# EasyEDA Pro project Archive.eprj, board GPR2.0
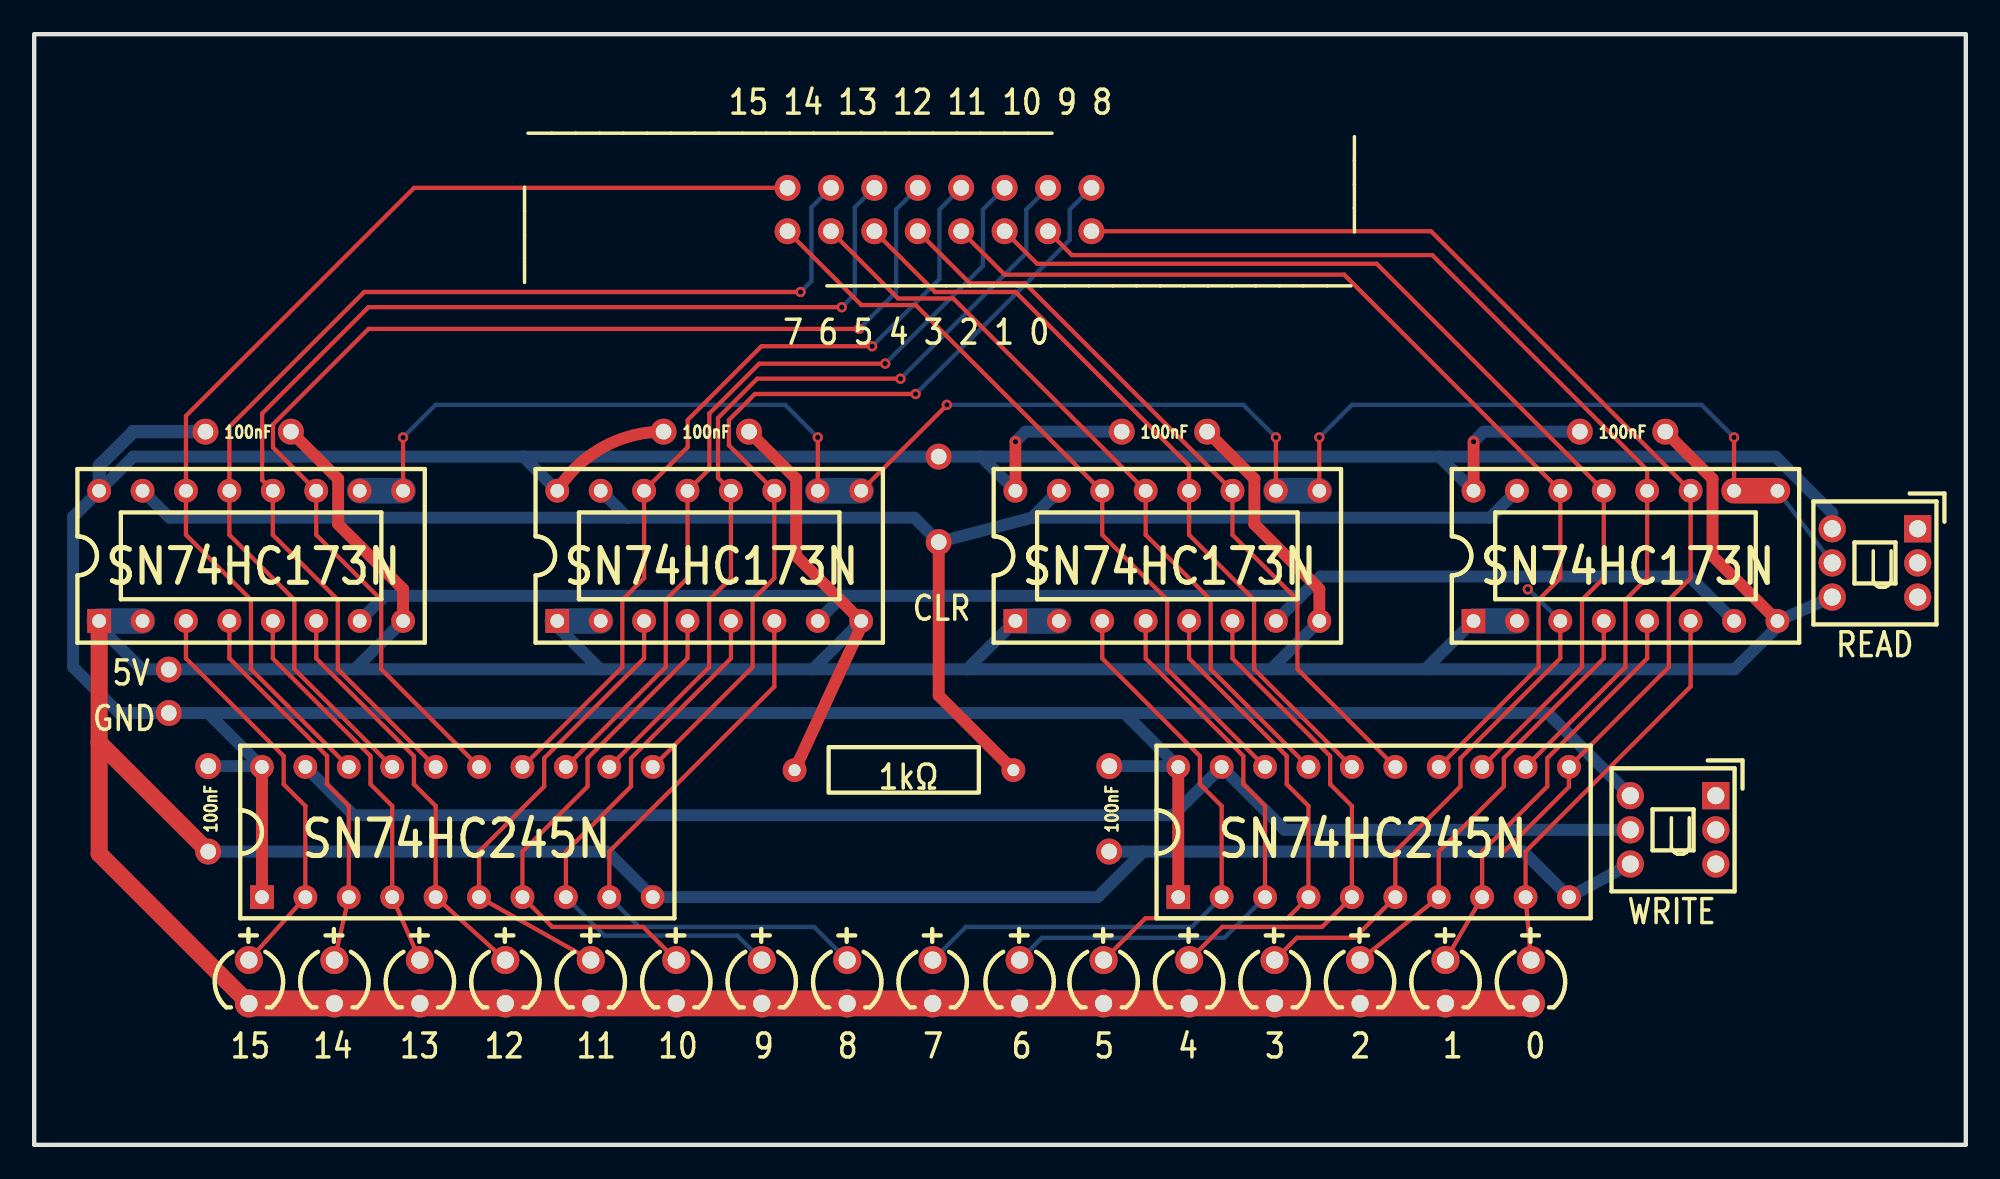
[diagram p6: board, top side]
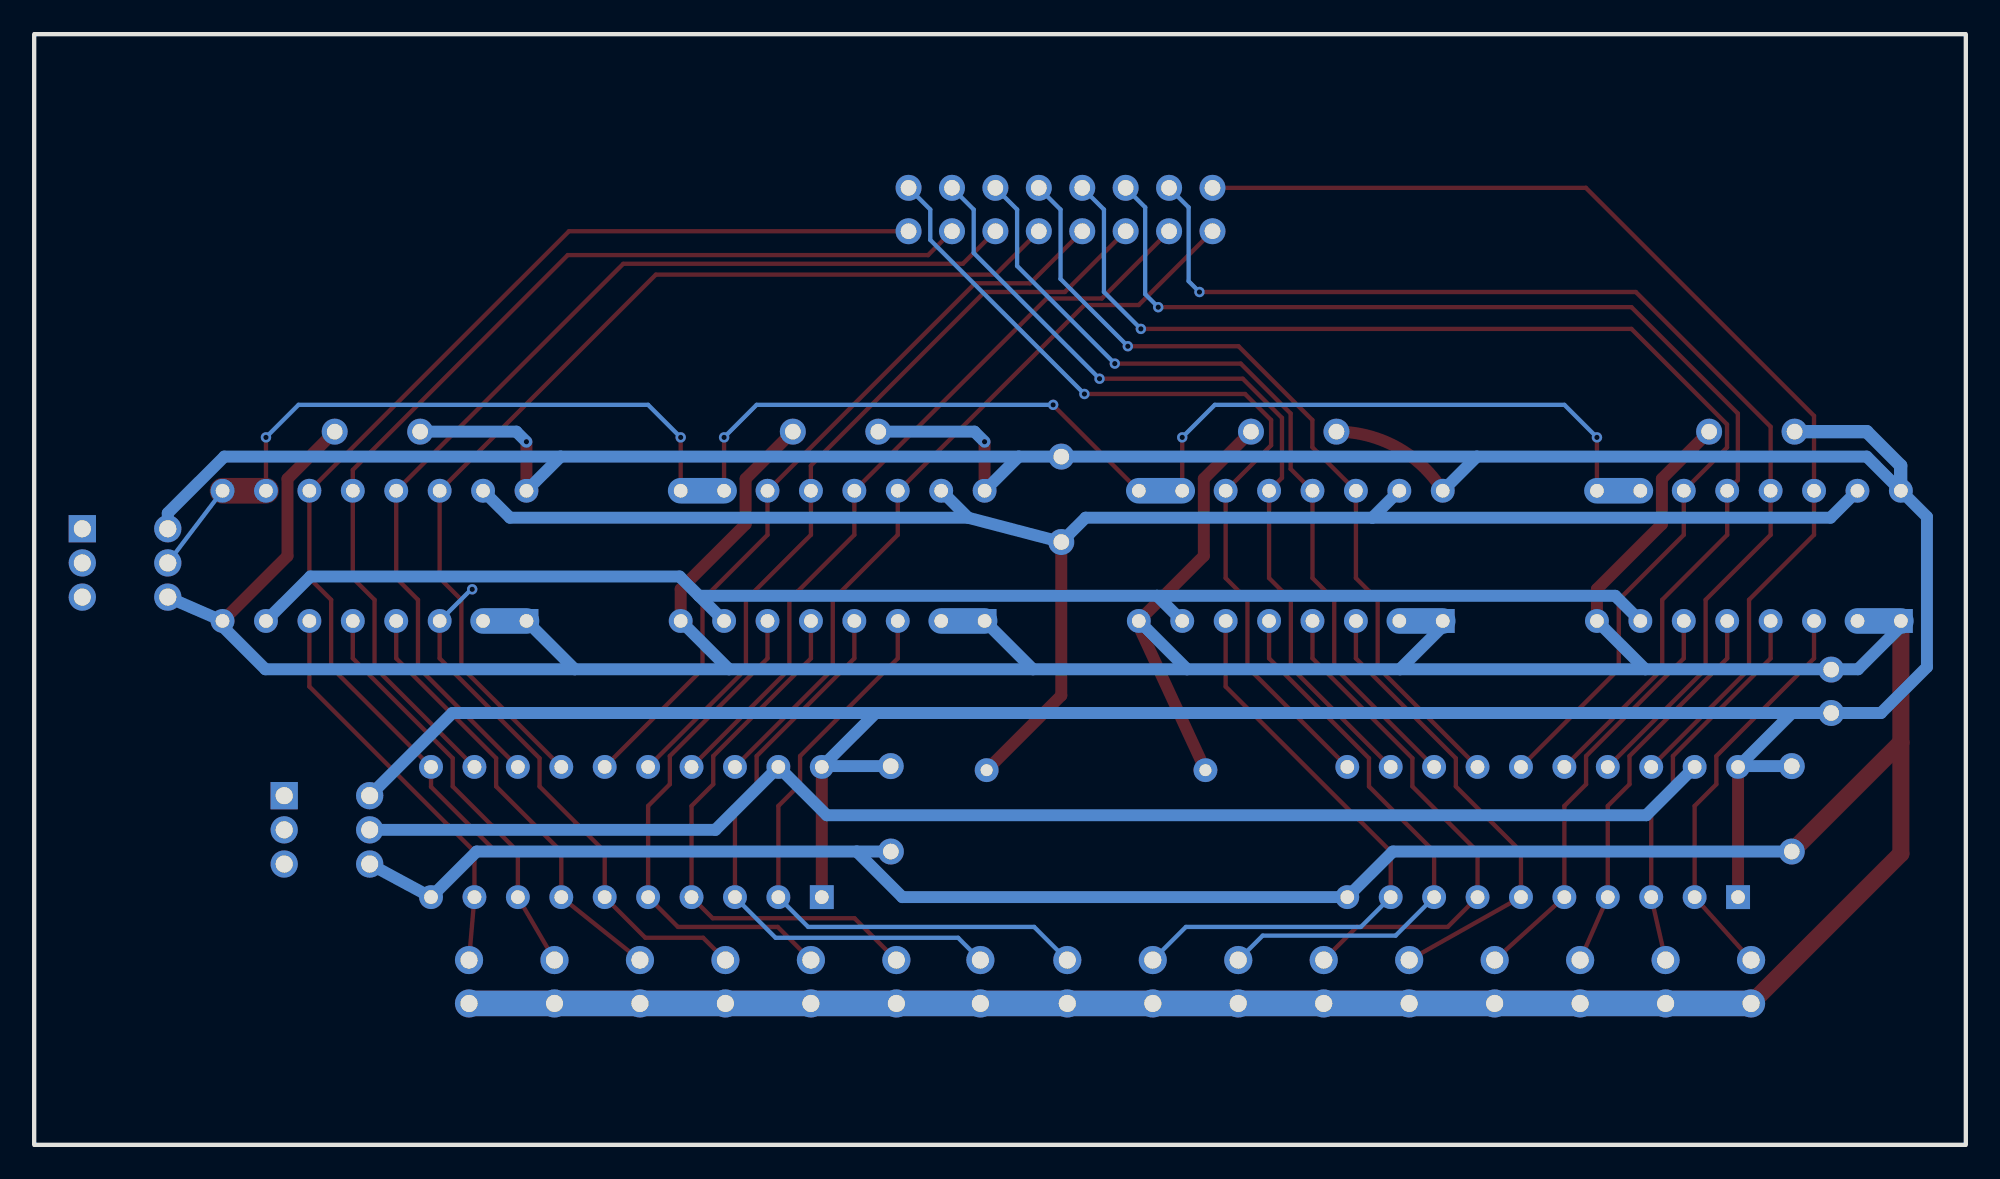
[diagram p7: board, bottom side, seen from below]

Outline 113 x 65 mm; copper layers: Top Layer, Bottom Layer. Coordinates in mm from the lower left corner of the outline.
Outline path: rectangle 0,65 113,0
Stack: Top Layer 0.035mm / Dielectric1 1.51mm FR4 er 4.5 / Bottom Layer 0.035mm

## Design rules (mm)
template: JLCPCB Capability(Two Layers Board)
spacing copperThickness1oz (default): track to track 0.102, other pairs 0.152 to 0.3
spacing copperThickness2oz: track to track 0.203, other pairs 0.152 to 0.3
track width copperThickness1oz (default): min 0.127, default 0.254, max 2.54
track width copperThickness2oz: min 0.203, default 0.254, max 2.54
differential pair differentialPair (default): width min 0.127, default 0.254, max 2.54; gap min 0.152, default 0.152
via viaSize (default): diameter min 0.5, default 0.61, max 10; hole min 0.3, default 0.305, max 6.3

## Placement (name value [footprint] x y rotation side)
NOREF  -  [Pad_e1288]  10.02 41.74 90 top
NOREF#2  -  [Pad_e1300]  62.89 22.16 180 top
NOREF#3  -  [Pad_e1421]  46.61 53.47 0 top
NOREF#4  -  [Pad_e1291]  41.82 41.74 90 top
NOREF#5  -  [Pad_e1292]  52.91 40.28 0 top
NOREF#6  -  [Pad_e1424]  49.15 53.47 0 top
NOREF#7  -  [Pad_e1430]  56.77 56.01 0 top
NOREF#8  -  [Pad_e1295]  10.18 22.16 180 top
NOREF#9  -  [Pad_e8]  7.87 27.81 0 top
NOREF#10  -  [Pad_e1434]  61.85 56.01 0 top
NOREF#11  -  [Pad_e1422]  46.61 56.01 0 top
NOREF#12  -  [Pad_e1423]  49.15 56.01 0 top
NOREF#13  -  [Pad_e1425]  51.69 53.47 0 top
NOREF#14  -  [Pad_e1429]  56.77 53.47 0 top
NOREF#15  -  [Pad_e1296]  52.91 35.28 0 top
NOREF#16  -  [Pad_e1420]  44.07 53.47 0 top
NOREF#17  -  [Pad_e1419]  44.07 56.01 0 top
NOREF#18  -  [Pad_e1433]  61.85 53.47 0 top
NOREF#19  -  [Pad_e1428]  54.23 53.47 0 top
NOREF#20  -  [Pad_e1293]  63.62 41.74 90 top
NOREF#21  -  [Pad_e9]  7.87 25.27 0 top
NOREF#22  -  [Pad_e1297]  68.62 41.74 90 top
NOREF#23  -  [Pad_e1432]  59.31 53.47 0 top
NOREF#24  -  [Pad_e1290]  36.82 41.74 90 top
NOREF#25  -  [Pad_e1301]  62.88 17.16 0 top
NOREF#26  -  [Pad_e1294]  10.18 17.16 180 top
NOREF#27  -  [Pad_e1289]  15.02 41.74 90 top
NOREF#28  -  [Pad_e1427]  54.23 56.01 0 top
NOREF#29  -  [Pad_e1426]  51.69 56.01 0 top
NOREF#30  -  [Pad_e1298]  90.42 41.74 90 top
NOREF#31  -  [Pad_e1299]  95.42 41.74 90 top
NOREF#32  -  [Pad_e1431]  59.31 56.01 0 top
SK1  -  [DIP-16_4816-3000-CP]  39.49 34.47 0 top
SK1#2  -  [DIP-16_4816-3000-CP]  12.69 34.47 0 top
SK1#3  -  [DIP-16_4816-3000-CP]  66.29 34.47 0 top
SK1#4  -  [DIP-16_4816-3000-CP]  93.09 34.47 0 top
SK2  -  [DIP-20_L25.4-W10.1-P2.54-LS7.6-BL]  24.75 18.31 0 top
SK2#2  -  [DIP-20_L25.4-W10.1-P2.54-LS7.6-BL]  78.36 18.31 0 top
SW2  -  [SW-TH_6P-L7.0-W7.0-P2.00]  95.87 18.43 0 top
SW2#2  -  [SW-TH_6P-L7.0-W7.0-P2.00]  107.69 34.06 0 top
U9  AXIAL-0.4  [RES-TH_BD2.7-L8.8-P12.80-D0.5]  50.88 21.93 0 top
U14  -  [LED-TH_BD4.0-P2.54-FD_RED]  87.56 9.54 270 top
U14#2  -  [LED-TH_BD4.0-P2.54-FD_RED]  12.56 9.54 270 top
U14#3  -  [LED-TH_BD4.0-P2.54-FD_RED]  17.56 9.54 270 top
U14#4  -  [LED-TH_BD4.0-P2.54-FD_RED]  22.56 9.54 270 top
U14#5  -  [LED-TH_BD4.0-P2.54-FD_RED]  27.56 9.54 270 top
U14#6  -  [LED-TH_BD4.0-P2.54-FD_RED]  32.56 9.54 270 top
U14#7  -  [LED-TH_BD4.0-P2.54-FD_RED]  37.56 9.54 270 top
U14#8  -  [LED-TH_BD4.0-P2.54-FD_RED]  42.56 9.54 270 top
U14#9  -  [LED-TH_BD4.0-P2.54-FD_RED]  47.56 9.54 270 top
U14#10  -  [LED-TH_BD4.0-P2.54-FD_RED]  52.56 9.54 270 top
U14#11  -  [LED-TH_BD4.0-P2.54-FD_RED]  57.65 9.54 270 top
U14#12  -  [LED-TH_BD4.0-P2.54-FD_RED]  62.56 9.54 270 top
U14#13  -  [LED-TH_BD4.0-P2.54-FD_RED]  67.56 9.54 270 top
U14#14  -  [LED-TH_BD4.0-P2.54-FD_RED]  72.56 9.54 270 top
U14#15  -  [LED-TH_BD4.0-P2.54-FD_RED]  77.56 9.54 270 top
U14#16  -  [LED-TH_BD4.0-P2.54-FD_RED]  82.56 9.54 270 top

## Footprints (pads in the part's own frame, mm; a bottom-side part is the same pattern mirrored in y, then rotated)
DIP-16_4816-3000-CP
  rect 1.4x1.4 hole 0.8: 1(-8.89,-3.81)
  round 1.4 hole 0.8: 2(-6.35,-3.81) 3(-3.81,-3.81) 4(-1.27,-3.81) 5(1.27,-3.81) 6(3.81,-3.81) 7(6.35,-3.81) 8(8.89,-3.81) 9(8.89,3.81) 10(6.35,3.81) 11(3.81,3.81) 12(1.27,3.81) 13(-1.27,3.81) 14(-3.81,3.81) 15(-6.35,3.81) 16(-8.89,3.81)
DIP-20_L25.4-W10.1-P2.54-LS7.6-BL
  rect 1.4x1.4 hole 0.8: 1(-11.43,-3.81)
  round 1.4 hole 0.8: 2(-8.89,-3.81) 3(-6.35,-3.81) 4(-3.81,-3.81) 5(-1.27,-3.81) 6(1.27,-3.81) 7(3.81,-3.81) 8(6.35,-3.81) 9(8.89,-3.81) 10(11.43,-3.81) 11(11.43,3.81) 12(8.89,3.81) 13(6.35,3.81) 14(3.81,3.81) 15(1.27,3.81) 16(-1.27,3.81) 17(-3.81,3.81) 18(-6.35,3.81) 19(-8.89,3.81) 20(-11.43,3.81)
LED-TH_BD4.0-P2.54-FD_RED
  round 1.651 hole 1: 1(-1.27,0) 2(1.27,0)
Pad_e8
  round 1.524 hole 0.914: 1(0,0)
Pad_e9
  round 1.524 hole 0.914: 2(0,0)
Pad_e1288
  round 1.524 hole 0.914: 2(0,0)
Pad_e1289
  round 1.524 hole 0.914: 1(0,0)
Pad_e1290
  round 1.524 hole 0.914: 2(0,0)
Pad_e1291
  round 1.524 hole 0.914: 1(0,0)
Pad_e1292
  round 1.524 hole 0.914: 2(0,0)
Pad_e1293
  round 1.524 hole 0.914: 2(0,0)
Pad_e1294
  round 1.524 hole 0.914: 1(0,0)
Pad_e1295
  round 1.524 hole 0.914: 2(0,0)
Pad_e1296
  round 1.524 hole 0.914: 1(0,0)
Pad_e1297
  round 1.524 hole 0.914: 1(0,0)
Pad_e1298
  round 1.524 hole 0.914: 2(0,0)
Pad_e1299
  round 1.524 hole 0.914: 1(0,0)
Pad_e1300
  round 1.524 hole 0.914: 2(0,0)
Pad_e1301
  round 1.524 hole 0.914: 1(0,0)
Pad_e1419
  round 1.524 hole 0.914: 1(0,0)
Pad_e1420
  round 1.524 hole 0.914: 1(0,0)
Pad_e1421
  round 1.524 hole 0.914: 2(0,0)
Pad_e1422
  round 1.524 hole 0.914: 2(0,0)
Pad_e1423
  round 1.524 hole 0.914: 3(0,0)
Pad_e1424
  round 1.524 hole 0.914: 3(0,0)
Pad_e1425
  round 1.524 hole 0.914: 2(0,0)
Pad_e1426
  round 1.524 hole 0.914: 2(0,0)
Pad_e1427
  round 1.524 hole 0.914: 3(0,0)
Pad_e1428
  round 1.524 hole 0.914: 3(0,0)
Pad_e1429
  round 1.524 hole 0.914: 2(0,0)
Pad_e1430
  round 1.524 hole 0.914: 2(0,0)
Pad_e1431
  round 1.524 hole 0.914: 3(0,0)
Pad_e1432
  round 1.524 hole 0.914: 3(0,0)
Pad_e1433
  round 1.524 hole 0.914: 2(0,0)
Pad_e1434
  round 1.524 hole 0.914: 2(0,0)
RES-TH_BD2.7-L8.8-P12.80-D0.5
  round 1.4 hole 0.7: 1(-6.4,0) 2(6.4,0)
SW-TH_6P-L7.0-W7.0-P2.00
  rect 1.6x1.6 hole 1: 1(2.499,2)
  round 1.6 hole 1: 2(2.5,0) 3(2.5,-2) 4(-2.5,2) 5(-2.5,0) 6(-2.5,-2)

## Nets

Pads without a net: NOREF 2; NOREF#2 2; NOREF#3 2; NOREF#4 1; NOREF#5 2; NOREF#6 3; NOREF#7 2; NOREF#8 2; NOREF#9 1; NOREF#10 2; NOREF#11 2; NOREF#12 3; NOREF#13 2; NOREF#14 2; NOREF#15 1; NOREF#16 1; NOREF#17 1; NOREF#18 2; NOREF#19 3; NOREF#20 2; NOREF#21 2; NOREF#22 1; NOREF#23 3; NOREF#24 2; NOREF#25 1; NOREF#26 1; NOREF#27 1; NOREF#28 3; NOREF#29 2; NOREF#30 2; NOREF#31 1; NOREF#32 3; SK1 1 2 3 4 5 6 7 8 9 10 11 12 13 14 15 16; SK1#2 1 2 3 4 5 6 7 8 9 10 11 12 13 14 15 16; SK1#3 1 2 3 4 5 6 7 8 9 10 11 12 13 14 15 16; SK1#4 1 2 3 4 5 6 7 8 9 10 11 12 13 14 15 16; SK2 1 2 3 4 5 6 7 8 9 10 11 12 13 14 15 16 17 18 19 20; SK2#2 1 2 3 4 5 6 7 8 9 10 11 12 13 14 15 16 17 18 19 20; SW2 1 2 3 4 5 6; SW2#2 1 2 3 4 5 6; U9 1 2; U14 1 2; U14#2 1 2; U14#3 1 2; U14#4 1 2; U14#5 1 2; U14#6 1 2; U14#7 1 2; U14#8 1 2; U14#9 1 2; U14#10 1 2; U14#11 1 2; U14#12 1 2; U14#13 1 2; U14#14 1 2; U14#15 1 2; U14#16 1 2

## Via types
v1: diameter 0.61, hole 0.305, Top Layer to Bottom Layer, 16 vias

## Routing (per net, layer and track width the routed paths; a pad name or vN(x,y) marks a point on that pad's centre or on a via; arc(x,y) is an arc through that point)
(no net): length 2498.6
  Top Layer w0.254: 62.48,30.34 62.48,28.47 68.2,22.75 68.2,21.1 69.47,19.83 SK2#2.2 ; SK2#2.18 66.28,27.84 66.28,31.9 62.48,35.7 SK1#3.14 62.43,38.28 51.56,49.15 48.39,49.15 NOREF#16.1 ; NOREF#23.3 60.71,52.07 81.79,52.07 94.36,39.5 94.36,33.17 93.09,31.9 93.09,27.96 SK2#2.12 ; v1(44.83,49.91) 19.3,49.91 11.42,42.03 SK1#2.13 11.42,35.7 15.22,31.9 15.22,27.84 SK2.17 ; SK1#4.10 v1(99.44,41.4) ; v1(49.02,46.74) 42.54,46.74 38.23,42.42 38.23,40.83 SK1.14 35.68,33.17 34.41,31.9 34.41,27.96 28.69,22.25 ; SK2.9 33.64,17.16 43.3,26.82 43.3,30.34 ; 67.56,30.34 67.56,28.47 73.28,22.75 73.28,21.1 74.55,19.83 SK2#2.4 73.31,13.26 65.01,13.26 U14#12.1 ; U14#2.1 SK2.2 15.86,19.83 14.59,21.1 14.59,22.75 8.88,28.47 8.88,30.34 ; U14#6.1 SK2.6 26.02,17.16 29.83,20.97 29.83,22.62 35.68,28.47 35.68,30.34 ; U14#7.1 35.62,12.75 30.31,12.75 SK2.7 28.56,17.16 32.37,20.97 32.37,22.62 38.22,28.47 38.22,30.34 ; U14#13.1 69.5,12.75 75.34,12.75 SK2#2.5 77.09,19.83 75.82,21.1 75.82,22.75 70.1,28.47 70.1,30.34 ; 91.82,30.34 91.82,28.47 85.98,22.62 85.98,20.97 82.17,17.16 SK2#2.7 U14#15.1 ; NOREF#13.2 54.74,50.42 57.96,50.42 SK1#3.11 70.1,35.7 73.9,31.9 73.9,27.84 SK2#2.15 ; U14#16.1 SK2#2.8 84.71,17.16 88.52,20.97 88.52,22.62 94.36,28.47 94.36,30.34 ; U14.1 SK2#2.9 87.25,17.16 96.9,26.82 96.9,30.34 ; NOREF#14.2 58.67,51.56 78.54,51.56 SK1#4.13 91.82,33.17 90.55,31.9 90.55,27.96 SK2#2.13 ; NOREF#18.2 81.71,53.47 SK1#4.11 96.9,33.17 95.63,31.9 95.63,27.96 SK2#2.11 89.79,20.95 85.98,17.14 ; 82.29,22.25 88.01,27.96 88.01,31.9 89.28,33.17 SK1#4.14 76.63,50.93 56.77,50.93 NOREF#19.3 ; NOREF#3.2 50.55,49.53 53.77,49.53 SK1#3.13 65.02,35.7 68.82,31.9 68.82,27.84 SK2#2.17 ; SK2#2.16 71.36,27.84 71.36,31.9 67.56,35.7 SK1#3.12 67.56,38.28 67.56,39.75 57.4,49.91 52.71,49.91 NOREF#6.3 ; SK2.16 17.76,27.84 17.76,31.9 13.96,35.7 13.96,38.28 13.33,38.9 13.33,42.8 19.56,49.02 v1(47.24,49.02) ; SK2.11 42.03,27.96 42.03,31.9 43.3,33.17 SK1.11 40.64,40.94 40.64,42.42 42.16,43.94 v1(51.56,43.94) ; U14#4.1 SK2.4 20.94,19.83 19.67,21.1 19.67,22.75 13.96,28.47 13.96,30.34 ; 11.42,30.34 11.42,28.47 17.13,22.75 17.13,21.1 18.4,19.83 SK2.3 U14#3.1 ; SK1#2.9 v1(21.58,41.4) ; v1(48.26,47.75) 19.56,47.75 13.97,42.16 13.97,40.81 SK1#2.11 16.5,35.7 20.3,31.9 20.3,27.84 SK2.15 ; SK2#2.3 72.01,19.83 70.74,21.1 70.74,22.75 65.02,28.47 65.02,30.34 ; NOREF#17.1 22.22,56.01 8.88,42.66 8.88,35.7 12.68,31.9 12.68,27.84 SK2.18 ; U14#5.1 SK2.5 23.48,19.83 22.21,21.1 22.21,22.75 16.5,28.47 16.5,30.34 ; SK1#3.9 v1(75.18,41.4) ; v1(50.68,44.84) 42.3,44.84 40,42.55 40,39.03 SK1.12 40.76,33.17 39.49,31.9 39.49,27.96 SK2.12 ; SK2.8 31.1,17.16 34.91,20.97 34.91,22.62 40.76,28.47 40.76,30.34 ; SK2.13 36.95,27.96 36.95,31.9 38.22,33.17 SK1.13 39.5,39.56 39.5,42.8 42.42,45.72 v1(49.78,45.72) ; SK1.9 53.41,43.31 ; U14#14.1 73.87,12.12 77.25,12.12 SK2#2.6 79.63,17.16 83.44,20.97 83.44,22.62 89.28,28.47 89.28,30.34 ; SK1.10 v1(45.84,41.4) ; SK1#3.10 v1(72.64,41.4)
  Top Layer w0.7: NOREF#22.1 71.38,38.98 71.38,36.32 75.18,32.52 75.18,30.66 ; 48.38,30.34 U9.1 ; NOREF#31.1 98.18,38.98 98.18,34.46 101.98,30.66 ; SK2#2.20 SK2#2.1 ; NOREF#4.1 44.58,38.98 44.58,34.46 48.38,30.66 ; SK1#3.16 57.4,38.28 v1(57.4,41.15) ; 84.2,38.28 84.2,38.28 v1(84.2,41.15) ; 21.58,30.66 21.58,32.52 17.78,36.32 17.78,38.98 NOREF#27.1 ; NOREF#15.1 52.91,26.3 U9.2 ; SK2.20 SK2.1 ; NOREF#24.2 arc(34.51,41.36) 32.43,40.28 arc(31.42,39.36) SK1.16
  Top Layer w1: 3.8,23.55 NOREF#26.1 ; 3.8,23.55 3.8,30.66 ; 3.8,23.55 3.8,17.04 U14#2.2
  Top Layer w1.5: SK1#4.10 SK1#4.9 ; U14.2 U14#16.2 U14#15.2 U14#14.2 U14#13.2 U14#12.2 U14#11.2 U14#10.2 U14#9.2 U14#8.2 U14#7.2 U14#6.2 U14#5.2 U14#4.2 U14#3.2 U14#2.2
  Bottom Layer w0.254: v1(47.24,49.02) 48.01,49.78 48.01,54.86 NOREF#12.3 ; U14#10.1 54.5,12.75 67.72,12.75 SK2#2.2 ; NOREF#7.2 55.5,54.74 55.5,51.44 v1(49.78,45.72) ; v1(21.58,41.4) 23.48,43.31 43.93,43.31 v1(45.84,41.4) ; NOREF#32.3 58.04,54.74 58.04,52.2 v1(50.68,44.84) ; SK2.8 33.36,12.24 41.13,12.24 U14#8.1 ; v1(99.44,41.4) 97.54,43.31 77.09,43.31 v1(75.18,41.4) ; NOREF#29.2 50.42,54.74 50.42,49.91 v1(48.26,47.75) ; v1(51.56,43.94) 60.58,52.96 60.58,54.74 NOREF#10.2 ; SK2#2.3 69.63,12.12 58.95,12.12 U14#11.1 ; SK1#4.9 SW2#2.5 ; v1(87.38,32.51) 87.43,32.51 89.28,30.66 ; NOREF#28.3 52.96,54.74 52.96,50.67 v1(49.02,46.74) ; SK2.9 35.39,12.75 45.62,12.75 U14#9.1 ; NOREF#11.2 45.47,54.86 45.47,50.55 v1(44.83,49.91) ; v1(53.39,43.31) 70.74,43.31 v1(72.64,41.4)
  Bottom Layer w0.7: 47.31,32.13 45.84,30.66 ; 47.31,32.13 20.51,32.13 19.04,30.66 ; 47.31,32.13 74.11,32.13 ; 55.4,40.28 82.2,40.28 ; 55.4,40.28 SK1#3.16 ; 55.4,40.28 NOREF#5.2 28.6,40.28 ; 82.2,40.28 101.88,40.28 105.19,36.97 SW2#2.4 ; 82.2,40.28 84.2,38.28 ; SK1#4.15 85.16,36.7 58.36,36.7 ; 81.37,27.83 84.2,30.66 ; 81.37,27.83 99.47,27.83 101.98,30.34 ; 81.37,27.83 72.35,27.83 ; 13.28,22.16 SK2.20 ; 13.28,22.16 NOREF#8.2 ; 13.28,22.16 10.17,25.27 ; 45.55,27.83 33.11,27.83 ; 45.55,27.83 54.57,27.83 ; 45.55,27.83 48.38,30.66 ; 33.11,27.83 18.75,27.83 ; 33.11,27.83 30.6,30.34 ; 58.36,36.7 SK1#3.15 ; 58.36,36.7 NOREF#15.1 51.49,36.7 34.72,36.7 ; 64.88,17.16 62.21,14.5 SK2.10 33.52,17.16 NOREF#26.1 ; 64.88,17.16 NOREF#25.1 ; 64.88,17.16 87.12,17.16 SK2#2.10 SW2.6 ; 28.6,40.28 5.8,40.28 2.28,36.75 2.28,27.96 4.96,25.27 NOREF#21.2 10.17,25.27 ; 28.6,40.28 SK1.16 ; 34.72,36.7 SK1.15 ; 34.72,36.7 7.92,36.7 SK1#2.15 ; SK2#2.19 73.15,18.43 SW2.5 ; SW2.4 88.53,25.27 63.77,25.27 ; 54.57,27.83 57.4,30.66 ; 54.57,27.83 72.35,27.83 ; SK2.19 18.69,19.29 66.63,19.29 69.46,22.12 ; NOREF#30.2 84.79,41.74 v1(84.2,41.15) ; 74.11,32.13 75.24,33.26 96.84,33.26 99.44,30.66 ; 74.11,32.13 72.64,30.66 ; 72.35,27.83 75.18,30.66 ; 63.77,25.27 10.17,25.27 ; 63.77,25.27 66.88,22.16 ; SW2#2.6 101.98,30.66 ; NOREF#20.2 57.99,41.74 v1(57.4,41.15) ; 18.75,27.83 6.31,27.83 3.8,30.34 ; 18.75,27.83 21.58,30.66 ; 66.88,22.16 NOREF#2.2 ; 66.88,22.16 SK2#2.20
  Bottom Layer w0.78: NOREF.2 5.8,41.74 3.81,39.75 3.81,38.29
  Bottom Layer w1.5: 19.04,38.28 SK1#2.9 ; SK1#3.10 SK1#3.9 ; 30.6,30.66 33.14,30.66 ; 3.8,30.66 6.34,30.66 ; U14#2.2 U14#3.2 U14#4.2 U14#5.2 U14#6.2 U14#7.2 U14#8.2 U14#9.2 U14#10.2 U14#11.2 U14#12.2 U14#13.2 U14#14.2 U14#15.2 U14#16.2 U14.2 ; SK1.10 SK1.9 ; 84.2,30.66 86.74,30.66 ; 57.4,30.66 59.94,30.66

## Text on the board
Top Silkscreen Layer: 100nF | GND | 5V | 15 14 13 12 11 10 9 8 | 7 6 5 4 3 2 1 0 | 1kΩ | WRITE | READ | CLR | 15 | 14 | 13 | 12 | 11 | 10 | 9 | 8 | 7 | 6 | 5 | 4 | 3 | 2 | 1 | 0 | SN74HC173N | ______________________ | U | ____ | SN74HC245N
